# Altium schematic sheet ProbadorDeCables_Accesorios_A_SZCNT_7.SchDoc
size A4
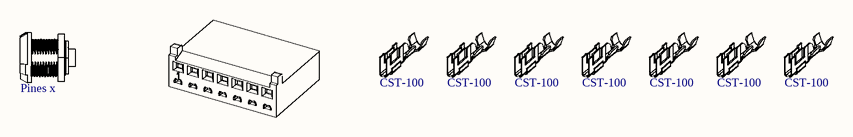
[diagram p0: ProbadorDeCables_Accesorios_A_SZCNT_7.SchDoc]

## Parts
BOM_A30  Pines: Pines x  [BOM_SZCNT_Hembra]  (hidden comment: SZCNT_0x_Hembra)  (mechanical)
BOM_A30__1  CST-100-7  [BOM_CST-100-7]  (value not drawn)  (mechanical)
BOM_A30__2  ParaHousing: CST-100  [BOM_sock_CST_1375819-1]  (hidden comment: sock_CST_1375819-1)  (mechanical)
BOM_A30__3  ParaHousing: CST-100  [BOM_sock_CST_1375819-1]  (hidden comment: sock_CST_1375819-1)  (mechanical)
BOM_A30__4  ParaHousing: CST-100  [BOM_sock_CST_1375819-1]  (hidden comment: sock_CST_1375819-1)  (mechanical)
BOM_A30__5  ParaHousing: CST-100  [BOM_sock_CST_1375819-1]  (hidden comment: sock_CST_1375819-1)  (mechanical)
BOM_A30__6  ParaHousing: CST-100  [BOM_sock_CST_1375819-1]  (hidden comment: sock_CST_1375819-1)  (mechanical)
BOM_A30__7  ParaHousing: CST-100  [BOM_sock_CST_1375819-1]  (hidden comment: sock_CST_1375819-1)  (mechanical)
BOM_A30__8  ParaHousing: CST-100  [BOM_sock_CST_1375819-1]  (hidden comment: sock_CST_1375819-1)  (mechanical)

## Library data of the parts
BOM_A30 = SZCNT_0x_Hembra: Conector SZCNT x vías hembra para gabinete; Cod.DigiKey: Se compra a SZCNT; Cod.Fabricante: *; ComponentLink1Description: Manufacturer Link; ComponentLink1URL: *; DIGIKEYx100: *; Fabricante: SZCNT; DIGIKEYx50: *
BOM_A30__1 = CST-100-7: CONN RCPT HSNG 7POS CST-100 II; Cod.Fabricante: 1375820-7; Fabricante: TE Connectivity AMP Connectors; Cod.DigiKey: A112102-ND; ComponentLink1Description: Manufacturer Link; ComponentLink1URL: https://www.te.com/commerce/DocumentDelivery/DDEController?Action=srchrtrv&DocNm=1375820&DocType=Customer+Drawing&DocLang=English; DIGIKEYx50: 0.29380; DIGIKEYx100: 0.28230
BOM_A30__2-BOM_A30__8 = sock_CST_1375819-1: CONN SOCKET 22-26AWG CRIMP TIN; Fabricante: TE Connectivity AMP Connectors; Cod.DigiKey: A100453CT-ND; Cod.Fabricante: 1375819-1; ComponentLink1Description: Manufacturer Link; ComponentLink1URL: https://www.te.com/commerce/DocumentDelivery/DDEController?Action=srchrtrv&DocNm=1375819&DocType=Customer+Drawing&DocLang=English; DIGIKEYx100: 0.04210; DIGIKEYx50: 0.03960